# EasyEDA Pro project kuafu01_030内部老化方案.eprj, board PCB4 (continued)
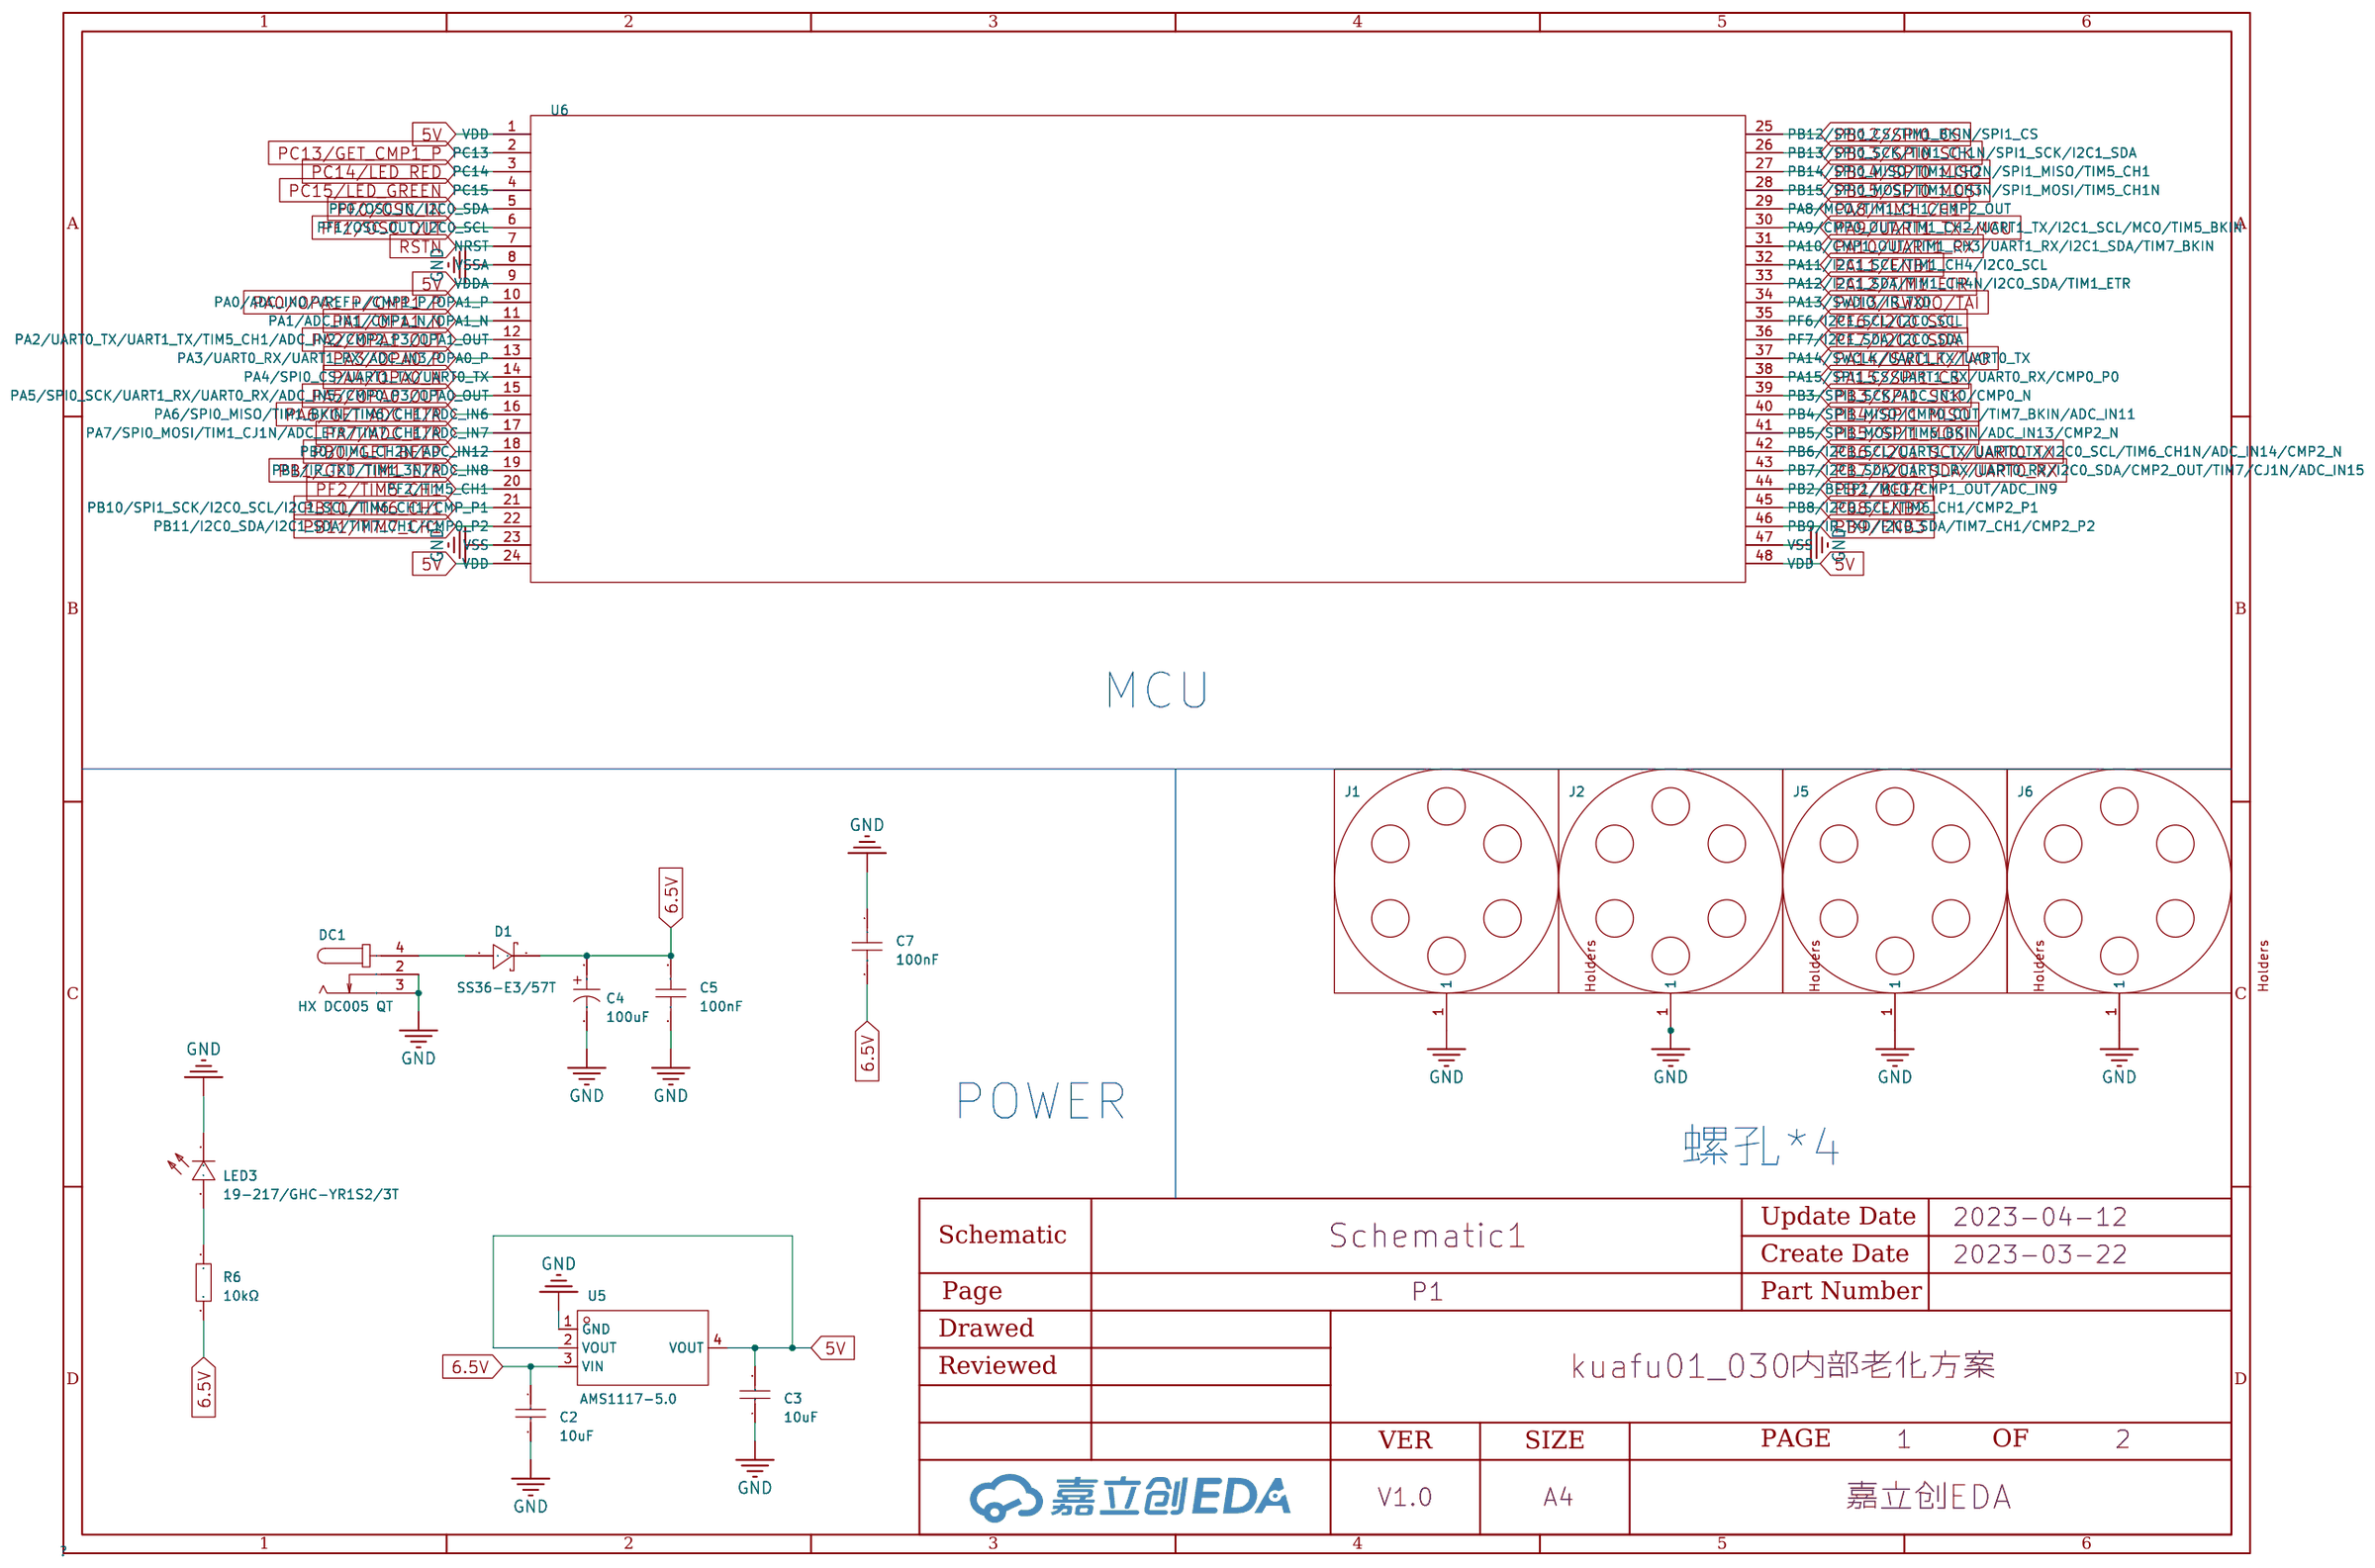
[diagram p0: P1]
## Routing (per net, layer and track width the routed paths; a pad name or vN(x,y) marks a point on that pad's centre or on a via; arc(x,y) is an arc through that point) (continued)
PF1/OSC_OUT: length 478.7
  Top Layer w0.254: 239.24,333.24 240.66,331.81 250.62,331.81 ; 36.04,180.84 37.46,179.41 47.42,179.41 ; 188.44,79.24 189.86,77.81 199.82,77.81 ; 199.82,128.61 189.86,128.61 188.44,130.04 ; 188.44,231.64 189.86,230.21 199.82,230.21 ; 250.62,27.01 240.66,27.01 239.24,28.44 ; 86.84,28.44 88.26,27.01 98.22,27.01 ; 250.62,281.01 240.66,281.01 239.24,282.44 ; 98.22,128.61 88.26,128.61 86.84,130.04 ; 290.04,231.64 291.46,230.21 301.42,230.21 ; 137.64,180.84 139.06,179.41 149.02,179.41 ; 290.04,79.24 291.46,77.81 301.42,77.81 ; 137.64,282.44 139.06,281.01 149.02,281.01 ; 36.04,79.24 37.46,77.81 47.42,77.81 ; 36.04,231.64 37.46,230.21 47.42,230.21 ; 137.64,231.64 139.06,230.21 149.02,230.21 ; 149.02,27.01 139.06,27.01 137.64,28.44 ; 149.02,77.81 139.06,77.81 137.64,79.24 ; 86.84,282.44 88.26,281.01 98.22,281.01 ; 301.42,281.01 291.46,281.01 290.04,282.44 ; 86.84,79.24 88.26,77.81 98.22,77.81 ; 239.24,130.04 240.66,128.61 250.62,128.61 ; 188.44,282.44 189.86,281.01 199.82,281.01 ; 188.44,333.24 189.86,331.81 199.82,331.81 ; 301.42,128.61 291.46,128.61 290.04,130.04 ; 188.44,28.44 189.86,27.01 199.82,27.01 ; 250.62,77.81 240.66,77.81 239.24,79.24 ; 98.22,230.21 88.26,230.21 86.84,231.64 ; 137.64,333.24 139.06,331.81 149.02,331.81 ; 36.04,28.44 37.46,27.01 47.42,27.01 ; 137.64,130.04 139.06,128.61 149.02,128.61 ; 36.04,282.44 37.46,281.01 47.42,281.01 ; 290.04,180.84 291.46,179.41 301.42,179.41 ; 250.62,179.41 240.66,179.41 239.24,180.84 ; 199.82,179.41 189.86,179.41 188.44,180.84 ; 290.04,333.24 291.46,331.81 301.42,331.81 ; 98.22,331.81 88.26,331.81 86.84,333.24 ; 47.42,128.61 37.46,128.61 36.04,130.04 ; 98.22,179.41 88.26,179.41 86.84,180.84 ; 250.62,230.21 240.66,230.21 239.24,231.64
PF6/I2C0_SCL: length 555
  Top Layer w0.254: 213.88,182.58 213.88,182.34 213.57,182.03 211.85,182.03 v1(211.62,181.79) 211.52,181.79 211.12,181.4 208.22,181.4 ; 213.88,334.98 213.88,334.74 213.57,334.43 211.85,334.43 v1(211.62,334.19) 211.52,334.19 211.12,333.8 208.22,333.8 ; 264.68,182.58 264.68,182.34 264.37,182.03 262.65,182.03 v1(262.42,181.79) 262.32,181.79 261.92,181.4 259.02,181.4 ; 59.23,123.75 59.57,124.09 v1(59.57,124.99) ; 213.88,233.38 213.88,233.14 213.57,232.83 211.85,232.83 v1(211.62,232.59) 211.52,232.59 211.12,232.2 208.22,232.2 ; 59.23,72.95 59.57,73.29 v1(59.57,74.19) ; v1(110.37,74.19) 110.37,73.29 110.03,72.95 ; 106.62,181.4 109.52,181.4 109.92,181.79 v1(110.02,181.79) 110.25,182.03 111.97,182.03 112.28,182.34 112.28,182.58 ; 110.03,174.55 110.37,174.89 v1(110.37,175.79) ; 211.63,326.95 211.97,327.29 v1(211.97,328.19) ; 259.02,130.6 261.92,130.6 262.32,130.99 v1(262.42,130.99) 262.65,131.23 264.37,131.23 264.68,131.54 264.68,131.78 ; 309.82,283 312.72,283 313.12,283.39 v1(313.22,283.39) 313.45,283.63 315.17,283.63 315.48,283.94 315.48,284.18 ; 259.02,232.2 261.92,232.2 262.32,232.59 v1(262.42,232.59) 262.65,232.83 264.37,232.83 264.68,233.14 264.68,233.38 ; v1(211.97,74.19) 211.97,73.29 211.63,72.95 ; v1(161.17,124.99) 161.17,124.09 160.83,123.75 ; 315.48,131.78 315.48,131.54 315.17,131.23 313.45,131.23 v1(313.22,130.99) 313.12,130.99 312.72,130.6 309.82,130.6 ; v1(110.37,328.19) 110.37,327.29 110.03,326.95 ; 106.62,232.2 109.52,232.2 109.92,232.59 v1(110.02,232.59) 110.25,232.83 111.97,232.83 112.28,233.14 112.28,233.38 ; 160.83,326.95 161.17,327.29 v1(161.17,328.19) ; 208.22,79.8 211.12,79.8 211.52,80.19 v1(211.62,80.19) 211.85,80.43 213.57,80.43 213.88,80.74 213.88,80.98 ; 208.22,283 211.12,283 211.52,283.39 v1(211.62,283.39) 211.85,283.63 213.57,283.63 213.88,283.94 213.88,284.18 ; v1(313.57,124.99) 313.57,124.09 313.23,123.75 ; 59.23,22.15 59.57,22.49 v1(59.57,23.39) ; 55.82,29 58.72,29 59.12,29.39 v1(59.22,29.39) 59.45,29.63 61.17,29.63 61.48,29.94 61.48,30.18 ; v1(262.77,74.19) 262.77,73.29 262.43,72.95 ; 264.68,334.98 264.68,334.74 264.37,334.43 262.65,334.43 v1(262.42,334.19) 262.32,334.19 261.92,333.8 259.02,333.8 ; 315.48,334.98 315.48,334.74 315.17,334.43 313.45,334.43 v1(313.22,334.19) 313.12,334.19 312.72,333.8 309.82,333.8 ; 309.82,79.8 312.72,79.8 313.12,80.19 v1(313.22,80.19) 313.45,80.43 315.17,80.43 315.48,80.74 315.48,80.98 ; 157.42,283 160.32,283 160.72,283.39 v1(160.82,283.39) 161.05,283.63 162.77,283.63 163.08,283.94 163.08,284.18 ; 213.88,30.18 213.88,29.94 213.57,29.63 211.85,29.63 v1(211.62,29.39) 211.52,29.39 211.12,29 208.22,29 ; 110.03,225.35 110.37,225.69 v1(110.37,226.59) ; 259.02,29 261.92,29 262.32,29.39 v1(262.42,29.39) 262.65,29.63 264.37,29.63 264.68,29.94 264.68,30.18 ; 106.62,333.8 109.52,333.8 109.92,334.19 v1(110.02,334.19) 110.25,334.43 111.97,334.43 112.28,334.74 112.28,334.98 ; 211.63,174.55 211.97,174.89 v1(211.97,175.79) ; 160.83,72.95 161.17,73.29 v1(161.17,74.19) ; v1(313.57,74.19) 313.57,73.29 313.23,72.95 ; v1(161.17,277.39) 161.17,276.49 160.83,276.15 ; 110.03,123.75 110.37,124.09 v1(110.37,124.99) ; 61.48,182.58 61.48,182.34 61.17,182.03 59.45,182.03 v1(59.22,181.79) 59.12,181.79 58.72,181.4 55.82,181.4 ; 262.43,225.35 262.77,225.69 v1(262.77,226.59) ; 211.63,225.35 211.97,225.69 v1(211.97,226.59) ; 163.08,80.98 163.08,80.74 162.77,80.43 161.05,80.43 v1(160.82,80.19) 160.72,80.19 160.32,79.8 157.42,79.8 ; 211.63,22.15 211.97,22.49 v1(211.97,23.39) ; 59.23,276.15 59.57,276.49 v1(59.57,277.39) ; 112.28,80.98 112.28,80.74 111.97,80.43 110.25,80.43 v1(110.02,80.19) 109.92,80.19 109.52,79.8 106.62,79.8 ; v1(313.57,175.79) 313.57,174.89 313.23,174.55 ; 112.28,284.18 112.28,283.94 111.97,283.63 110.25,283.63 v1(110.02,283.39) 109.92,283.39 109.52,283 106.62,283 ; 262.43,276.15 262.77,276.49 v1(262.77,277.39) ; 315.48,233.38 315.48,233.14 315.17,232.83 313.45,232.83 v1(313.22,232.59) 313.12,232.59 312.72,232.2 309.82,232.2 ; 112.28,131.78 112.28,131.54 111.97,131.23 110.25,131.23 v1(110.02,130.99) 109.92,130.99 109.52,130.6 106.62,130.6 ; 313.23,276.15 313.57,276.49 v1(313.57,277.39) ; v1(161.17,226.59) 161.17,225.69 160.83,225.35 ; v1(211.97,277.39) 211.97,276.49 211.63,276.15 ; 163.08,182.58 163.08,182.34 162.77,182.03 161.05,182.03 v1(160.82,181.79) 160.72,181.79 160.32,181.4 157.42,181.4 ; 157.42,232.2 160.32,232.2 160.72,232.59 v1(160.82,232.59) 161.05,232.83 162.77,232.83 163.08,233.14 163.08,233.38 ; v1(211.97,124.99) 211.97,124.09 211.63,123.75 ; 262.43,174.55 262.77,174.89 v1(262.77,175.79) ; 157.42,333.8 160.32,333.8 160.72,334.19 v1(160.82,334.19) 161.05,334.43 162.77,334.43 163.08,334.74 163.08,334.98 ; 112.28,30.18 112.28,29.94 111.97,29.63 110.25,29.63 v1(110.02,29.39) 109.92,29.39 109.52,29 106.62,29 ; v1(262.77,124.99) 262.77,124.09 262.43,123.75 ; 157.42,130.6 160.32,130.6 160.72,130.99 v1(160.82,130.99) 161.05,131.23 162.77,131.23 163.08,131.54 163.08,131.78 ; v1(59.57,226.59) 59.57,225.69 59.23,225.35 ; v1(313.57,328.19) 313.57,327.29 313.23,326.95 ; 163.08,30.18 163.08,29.94 162.77,29.63 161.05,29.63 v1(160.82,29.39) 160.72,29.39 160.32,29 157.42,29 ; v1(110.37,23.39) 110.37,22.49 110.03,22.15 ; 264.68,284.18 264.68,283.94 264.37,283.63 262.65,283.63 v1(262.42,283.39) 262.32,283.39 261.92,283 259.02,283 ; 55.82,232.2 58.72,232.2 59.12,232.59 v1(59.22,232.59) 59.45,232.83 61.17,232.83 61.48,233.14 61.48,233.38 ; 61.48,284.18 61.48,283.94 61.17,283.63 59.45,283.63 v1(59.22,283.39) 59.12,283.39 58.72,283 55.82,283 ; 315.48,182.58 315.48,182.34 315.17,182.03 313.45,182.03 v1(313.22,181.79) 313.12,181.79 312.72,181.4 309.82,181.4 ; 55.82,130.6 58.72,130.6 59.12,130.99 v1(59.22,130.99) 59.45,131.23 61.17,131.23 61.48,131.54 61.48,131.78 ; 110.03,276.15 110.37,276.49 v1(110.37,277.39) ; v1(313.57,226.59) 313.57,225.69 313.23,225.35 ; 160.83,174.55 161.17,174.89 v1(161.17,175.79) ; 264.68,80.98 264.68,80.74 264.37,80.43 262.65,80.43 v1(262.42,80.19) 262.32,80.19 261.92,79.8 259.02,79.8 ; 262.43,22.15 262.77,22.49 v1(262.77,23.39) ; 262.43,326.95 262.77,327.29 v1(262.77,328.19) ; 55.82,79.8 58.72,79.8 59.12,80.19 v1(59.22,80.19) 59.45,80.43 61.17,80.43 61.48,80.74 61.48,80.98 ; 59.23,174.55 59.57,174.89 v1(59.57,175.79) ; 213.88,131.78 213.88,131.54 213.57,131.23 211.85,131.23 v1(211.62,130.99) 211.52,130.99 211.12,130.6 208.22,130.6 ; 160.83,22.15 161.17,22.49 v1(161.17,23.39)
  Bottom Layer w0.254: v1(160.82,130.99) 161.23,130.58 161.23,125.04 v1(161.17,124.99) ; v1(161.17,277.39) 161.23,277.44 161.23,282.98 v1(160.82,283.39) ; v1(262.77,175.79) 262.82,175.84 262.82,181.38 v1(262.42,181.79) ; v1(110.37,277.39) 110.42,277.44 110.42,282.98 v1(110.02,283.39) ; v1(262.77,124.99) 262.82,125.04 262.82,130.58 v1(262.42,130.99) ; v1(110.02,80.19) 110.42,79.78 110.42,74.24 v1(110.37,74.19) ; v1(161.17,226.59) 161.23,226.64 161.23,232.18 v1(160.82,232.59) ; v1(262.77,277.39) 262.82,277.44 262.82,282.98 v1(262.42,283.39) ; v1(262.42,80.19) 262.82,79.78 262.82,74.24 v1(262.77,74.19) ; v1(313.22,181.79) 313.62,181.38 313.62,175.84 v1(313.57,175.79) ; v1(211.97,328.19) 212.03,328.24 212.03,333.78 v1(211.62,334.19) ; v1(161.17,74.19) 161.23,74.24 161.23,79.78 v1(160.82,80.19) ; v1(160.82,334.19) 161.23,333.78 161.23,328.24 v1(161.17,328.19) ; v1(59.57,124.99) 59.62,125.04 59.62,130.58 v1(59.22,130.99) ; v1(110.02,130.99) 110.42,130.58 110.42,125.04 v1(110.37,124.99) ; v1(262.42,334.19) 262.82,333.78 262.82,328.24 v1(262.77,328.19) ; v1(262.77,23.39) 262.82,23.44 262.82,28.98 v1(262.42,29.39) ; v1(211.97,226.59) 212.03,226.64 212.03,232.18 v1(211.62,232.59) ; v1(59.57,23.39) 59.62,23.44 59.62,28.98 v1(59.22,29.39) ; v1(110.37,23.39) 110.42,23.44 110.42,28.98 v1(110.02,29.39) ; v1(110.02,334.19) 110.42,333.78 110.42,328.24 v1(110.37,328.19) ; v1(211.62,130.99) 212.03,130.58 212.03,125.04 v1(211.97,124.99) ; v1(211.62,80.19) 212.03,79.78 212.03,74.24 v1(211.97,74.19) ; v1(313.22,80.19) 313.62,79.78 313.62,74.24 v1(313.57,74.19) ; v1(59.22,80.19) 59.62,79.78 59.62,74.24 v1(59.57,74.19) ; v1(59.57,277.39) 59.62,277.44 59.62,282.98 v1(59.22,283.39) ; v1(110.02,232.59) 110.42,232.18 110.42,226.64 v1(110.37,226.59) ; v1(59.57,226.59) 59.62,226.64 59.62,232.18 v1(59.22,232.59) ; v1(59.22,181.79) 59.62,181.38 59.62,175.84 v1(59.57,175.79) ; v1(110.02,181.79) 110.42,181.38 110.42,175.84 v1(110.37,175.79) ; v1(313.57,226.59) 313.62,226.64 313.62,232.18 v1(313.22,232.59) ; v1(211.62,29.39) 212.03,28.98 212.03,23.44 v1(211.97,23.39) ; v1(211.62,181.79) 212.03,181.38 212.03,175.84 v1(211.97,175.79) ; v1(313.57,328.19) 313.62,328.24 313.62,333.78 v1(313.22,334.19) ; v1(161.17,175.79) 161.23,175.84 161.23,181.38 v1(160.82,181.79) ; v1(313.22,130.99) 313.62,130.58 313.62,125.04 v1(313.57,124.99) ; v1(262.77,226.59) 262.82,226.64 262.82,232.18 v1(262.42,232.59) ; v1(211.97,277.39) 212.03,277.44 212.03,282.98 v1(211.62,283.39) ; v1(161.17,23.39) 161.23,23.44 161.23,28.98 v1(160.82,29.39) ; v1(313.57,277.39) 313.62,277.44 313.62,282.98 v1(313.22,283.39)
PF7/I2C0_SDA: length 1019.3
  Top Layer w0.254: v1(209.15,284.56) 208.11,283.51 207.96,283.51 ; v1(99.48,339.39) 97.61,339.39 97.02,339.98 ; 249.42,85.98 250.01,85.39 v1(251.88,85.39) ; v1(158.35,132.16) 157.31,131.11 157.16,131.11 ; 258.76,131.11 258.91,131.11 v1(259.95,132.16) ; 198.62,136.78 199.21,136.19 v1(201.08,136.19) ; v1(108.4,22.14) 108.4,20.73 108.65,20.48 109.53,20.48 ; v1(209.15,30.56) 208.11,29.51 207.96,29.51 ; v1(48.68,288.59) 46.81,288.59 46.22,289.18 ; v1(56.75,132.16) 55.71,131.11 55.56,131.11 ; v1(209.15,132.16) 208.11,131.11 207.96,131.11 ; v1(251.88,34.59) 250.01,34.59 249.42,35.18 ; 300.22,85.98 300.81,85.39 v1(302.68,85.39) ; v1(302.68,339.39) 300.81,339.39 300.22,339.98 ; 309.56,334.31 309.71,334.31 v1(310.75,335.36) ; 261.93,325.28 261.05,325.28 260.8,325.53 v1(260.8,326.94) ; v1(302.68,186.99) 300.81,186.99 300.22,187.58 ; 55.56,181.91 55.71,181.91 v1(56.75,182.95) ; v1(48.68,85.39) 46.81,85.39 46.22,85.98 ; v1(150.28,85.39) 148.41,85.39 147.82,85.98 ; v1(150.28,136.19) 148.41,136.19 147.82,136.78 ; 109.53,172.88 108.65,172.88 108.4,173.13 v1(108.4,174.54) ; 160.33,122.08 159.45,122.08 159.2,122.33 v1(159.2,123.74) ; v1(260.8,276.14) 260.8,274.73 261.05,274.48 261.93,274.48 ; v1(259.95,182.95) 258.91,181.91 258.76,181.91 ; v1(210,72.94) 210,71.53 210.25,71.28 211.13,71.28 ; 211.13,274.48 210.25,274.48 210,274.73 v1(210,276.14) ; 157.16,181.91 157.31,181.91 v1(158.35,182.95) ; 261.93,20.48 261.05,20.48 260.8,20.73 v1(260.8,22.14) ; 157.16,232.71 157.31,232.71 v1(158.35,233.75) ; 300.22,289.18 300.81,288.59 v1(302.68,288.59) ; 258.76,232.71 258.91,232.71 v1(259.95,233.75) ; v1(251.88,288.59) 250.01,288.59 249.42,289.18 ; 106.36,283.51 106.51,283.51 v1(107.55,284.56) ; 249.42,187.58 250.01,186.99 v1(251.88,186.99) ; 300.22,136.78 300.81,136.19 v1(302.68,136.19) ; 157.16,334.31 157.31,334.31 v1(158.35,335.36) ; 261.93,172.88 261.05,172.88 260.8,173.13 v1(260.8,174.54) ; v1(99.48,85.39) 97.61,85.39 97.02,85.98 ; v1(150.28,237.79) 148.41,237.79 147.82,238.38 ; 309.56,80.31 309.71,80.31 v1(310.75,81.35) ; 261.93,122.08 261.05,122.08 260.8,122.33 v1(260.8,123.74) ; v1(210,123.74) 210,122.33 210.25,122.08 211.13,122.08 ; v1(57.6,22.14) 57.6,20.73 57.85,20.48 58.73,20.48 ; 207.96,181.91 208.11,181.91 v1(209.15,182.95) ; v1(210,225.34) 210,223.93 210.25,223.68 211.13,223.68 ; v1(311.6,225.34) 311.6,223.93 311.85,223.68 312.73,223.68 ; 211.13,20.48 210.25,20.48 210,20.73 v1(210,22.14) ; 258.76,283.51 258.91,283.51 v1(259.95,284.56) ; v1(251.88,339.39) 250.01,339.39 249.42,339.98 ; 46.22,136.78 46.81,136.19 v1(48.68,136.19) ; v1(259.95,335.36) 258.91,334.31 258.76,334.31 ; v1(159.2,276.14) 159.2,274.73 159.45,274.48 160.33,274.48 ; 147.82,35.18 148.41,34.59 v1(150.28,34.59) ; 157.16,283.51 157.31,283.51 v1(158.35,284.56) ; v1(107.55,233.75) 106.51,232.71 106.36,232.71 ; v1(310.75,132.16) 309.71,131.11 309.56,131.11 ; v1(311.6,174.54) 311.6,173.13 311.85,172.88 312.73,172.88 ; v1(56.75,30.56) 55.71,29.51 55.56,29.51 ; v1(311.6,276.14) 311.6,274.73 311.85,274.48 312.73,274.48 ; v1(108.4,326.94) 108.4,325.53 108.65,325.28 109.53,325.28 ; 160.33,223.68 159.45,223.68 159.2,223.93 v1(159.2,225.34) ; 309.56,181.91 309.71,181.91 v1(310.75,182.95) ; v1(311.6,123.74) 311.6,122.33 311.85,122.08 312.73,122.08 ; v1(48.68,186.99) 46.81,186.99 46.22,187.58 ; v1(108.4,225.34) 108.4,223.93 108.65,223.68 109.53,223.68 ; v1(108.4,276.14) 108.4,274.73 108.65,274.48 109.53,274.48 ; v1(108.4,123.74) 108.4,122.33 108.65,122.08 109.53,122.08 ; v1(310.75,233.75) 309.71,232.71 309.56,232.71 ; 258.76,29.51 258.91,29.51 v1(259.95,30.56) ; 58.73,223.68 57.85,223.68 57.6,223.93 v1(57.6,225.34) ; 55.56,80.31 55.71,80.31 v1(56.75,81.35) ; 198.62,289.18 199.21,288.59 v1(201.08,288.59) ; 261.93,223.68 261.05,223.68 260.8,223.93 v1(260.8,225.34) ; 198.62,238.38 199.21,237.79 v1(201.08,237.79) ; 97.02,238.38 97.61,237.79 v1(99.48,237.79) ; 106.36,334.31 106.51,334.31 v1(107.55,335.36) ; 249.42,136.78 250.01,136.19 v1(251.88,136.19) ; 97.02,136.78 97.61,136.19 v1(99.48,136.19) ; 198.62,339.98 199.21,339.39 v1(201.08,339.39) ; 147.82,187.58 148.41,186.99 v1(150.28,186.99) ; v1(259.95,81.35) 258.91,80.31 258.76,80.31 ; 58.73,71.28 57.85,71.28 57.6,71.53 v1(57.6,72.94) ; v1(201.08,85.39) 199.21,85.39 198.62,85.98 ; v1(107.55,182.95) 106.51,181.91 106.36,181.91 ; v1(159.2,22.14) 159.2,20.73 159.45,20.48 160.33,20.48 ; 106.36,80.31 106.51,80.31 v1(107.55,81.35) ; 312.73,325.28 311.85,325.28 311.6,325.53 v1(311.6,326.94) ; 97.02,187.58 97.61,186.99 v1(99.48,186.99) ; v1(158.35,30.56) 157.31,29.51 157.16,29.51 ; 46.22,238.38 46.81,237.79 v1(48.68,237.79) ; v1(210,174.54) 210,173.13 210.25,172.88 211.13,172.88 ; 261.93,71.28 261.05,71.28 260.8,71.53 v1(260.8,72.94) ; 300.22,238.38 300.81,237.79 v1(302.68,237.79) ; v1(56.75,284.56) 55.71,283.51 55.56,283.51 ; 109.53,71.28 108.65,71.28 108.4,71.53 v1(108.4,72.94) ; 207.96,334.31 208.11,334.31 v1(209.15,335.36) ; v1(150.28,288.59) 148.41,288.59 147.82,289.18 ; v1(159.2,326.94) 159.2,325.53 159.45,325.28 160.33,325.28 ; 106.36,29.51 106.51,29.51 v1(107.55,30.56) ; v1(201.08,34.59) 199.21,34.59 198.62,35.18 ; v1(99.48,34.59) 97.61,34.59 97.02,35.18 ; v1(150.28,339.39) 148.41,339.39 147.82,339.98 ; 157.16,80.31 157.31,80.31 v1(158.35,81.35) ; 55.56,232.71 55.71,232.71 v1(56.75,233.75) ; v1(57.6,276.14) 57.6,274.73 57.85,274.48 58.73,274.48 ; 211.13,325.28 210.25,325.28 210,325.53 v1(210,326.94) ; 198.62,187.58 199.21,186.99 v1(201.08,186.99) ; v1(159.2,174.54) 159.2,173.13 159.45,172.88 160.33,172.88 ; 58.73,172.88 57.85,172.88 57.6,173.13 v1(57.6,174.54) ; v1(209.15,233.75) 208.11,232.71 207.96,232.71 ; 249.42,238.38 250.01,237.79 v1(251.88,237.79) ; 58.73,122.08 57.85,122.08 57.6,122.33 v1(57.6,123.74) ; 106.36,131.11 106.51,131.11 v1(107.55,132.16) ; v1(48.68,34.59) 46.81,34.59 46.22,35.18 ; 312.73,71.28 311.85,71.28 311.6,71.53 v1(311.6,72.94) ; 97.02,289.18 97.61,288.59 v1(99.48,288.59) ; 207.96,80.31 208.11,80.31 v1(209.15,81.35) ; 309.56,283.51 309.71,283.51 v1(310.75,284.56) ; 160.33,71.28 159.45,71.28 159.2,71.53 v1(159.2,72.94)
  Bottom Layer w0.254: v1(260.8,225.34) 260.8,232.91 v1(259.95,233.75) 255.98,237.73 251.94,237.73 v1(251.88,237.79) ; v1(251.88,34.59) 251.94,34.53 255.98,34.53 v1(259.95,30.56) 260.8,29.71 v1(260.8,22.14) ; v1(201.08,136.19) 201.14,136.13 205.18,136.13 v1(209.15,132.16) 210,131.31 v1(210,123.74) ; v1(251.88,85.39) 251.94,85.33 255.98,85.33 v1(259.95,81.35) 260.8,80.51 v1(260.8,72.94) ; v1(99.48,34.59) 99.54,34.53 103.58,34.53 v1(107.55,30.56) 108.4,29.71 v1(108.4,22.14) ; v1(311.6,123.74) 311.6,131.31 v1(310.75,132.16) 306.78,136.13 302.74,136.13 v1(302.68,136.19) ; v1(108.4,326.94) 108.4,334.51 v1(107.55,335.36) 103.58,339.33 99.54,339.33 v1(99.48,339.39) ; v1(57.6,22.14) 57.6,29.71 v1(56.75,30.56) 52.78,34.53 48.74,34.53 v1(48.68,34.59) ; v1(48.68,136.19) 48.74,136.13 52.78,136.13 v1(56.75,132.16) 57.6,131.31 v1(57.6,123.74) ; v1(48.68,288.59) 48.74,288.53 52.78,288.53 v1(56.75,284.56) 57.6,283.71 v1(57.6,276.14) ; v1(99.48,136.19) 99.54,136.13 103.58,136.13 v1(107.55,132.16) 108.4,131.31 v1(108.4,123.74) ; v1(201.08,288.59) 201.14,288.53 205.18,288.53 v1(209.15,284.56) 210,283.71 v1(210,276.14) ; v1(108.4,225.34) 108.4,232.91 v1(107.55,233.75) 103.58,237.73 99.54,237.73 v1(99.48,237.79) ; v1(302.68,85.39) 302.74,85.33 306.78,85.33 v1(310.75,81.35) 311.6,80.51 v1(311.6,72.94) ; v1(251.88,339.39) 251.94,339.33 255.98,339.33 v1(259.95,335.36) 260.8,334.51 v1(260.8,326.94) ; v1(201.08,34.59) 201.14,34.53 205.18,34.53 v1(209.15,30.56) 210,29.71 v1(210,22.14) ; v1(150.28,339.39) 150.34,339.33 154.38,339.33 v1(158.35,335.36) 159.2,334.51 v1(159.2,326.94) ; v1(302.68,339.39) 302.74,339.33 306.78,339.33 v1(310.75,335.36) 311.6,334.51 v1(311.6,326.94) ; v1(210,225.34) 210,232.91 v1(209.15,233.75) 205.18,237.73 201.14,237.73 v1(201.08,237.79) ; v1(260.8,174.54) 260.8,182.11 v1(259.95,182.95) 255.98,186.93 251.94,186.93 v1(251.88,186.99) ; v1(48.68,237.79) 48.74,237.73 52.78,237.73 v1(56.75,233.75) 57.6,232.91 v1(57.6,225.34) ; v1(48.68,186.99) 48.74,186.93 52.78,186.93 v1(56.75,182.95) 57.6,182.11 v1(57.6,174.54) ; v1(159.2,22.14) 159.2,29.71 v1(158.35,30.56) 154.38,34.53 150.34,34.53 v1(150.28,34.59) ; v1(201.08,339.39) 201.14,339.33 205.18,339.33 v1(209.15,335.36) 210,334.51 v1(210,326.94) ; v1(311.6,174.54) 311.6,182.11 v1(310.75,182.95) 306.78,186.93 302.74,186.93 v1(302.68,186.99) ; v1(150.28,237.79) 150.34,237.73 154.38,237.73 v1(158.35,233.75) 159.2,232.91 v1(159.2,225.34) ; v1(159.2,123.74) 159.2,131.31 v1(158.35,132.16) 154.38,136.13 150.34,136.13 v1(150.28,136.19) ; v1(201.08,85.39) 201.14,85.33 205.18,85.33 v1(209.15,81.35) 210,80.51 v1(210,72.94) ; v1(108.4,72.94) 108.4,80.51 v1(107.55,81.35) 103.58,85.33 99.54,85.33 v1(99.48,85.39) ; v1(302.68,237.79) 302.74,237.73 306.78,237.73 v1(310.75,233.75) 311.6,232.91 v1(311.6,225.34) ; v1(108.4,276.14) 108.4,283.71 v1(107.55,284.56) 103.58,288.53 99.54,288.53 v1(99.48,288.59) ; v1(311.6,276.14) 311.6,283.71 v1(310.75,284.56) 306.78,288.53 302.74,288.53 v1(302.68,288.59) ; v1(260.8,276.14) 260.8,283.71 v1(259.95,284.56) 255.98,288.53 251.94,288.53 v1(251.88,288.59) ; v1(159.2,72.94) 159.2,80.51 v1(158.35,81.35) 154.38,85.33 150.34,85.33 v1(150.28,85.39) ; v1(210,174.54) 210,182.11 v1(209.15,182.95) 205.18,186.93 201.14,186.93 v1(201.08,186.99) ; v1(57.6,72.94) 57.6,80.51 v1(56.75,81.35) 52.78,85.33 48.74,85.33 v1(48.68,85.39) ; v1(260.8,123.74) 260.8,131.31 v1(259.95,132.16) 255.98,136.13 251.94,136.13 v1(251.88,136.19) ; v1(150.28,288.59) 150.34,288.53 154.38,288.53 v1(158.35,284.56) 159.2,283.71 v1(159.2,276.14) ; v1(108.4,174.54) 108.4,182.11 v1(107.55,182.95) 103.58,186.93 99.54,186.93 v1(99.48,186.99) ; v1(159.2,174.54) 159.2,182.11 v1(158.35,182.95) 154.38,186.93 150.34,186.93 v1(150.28,186.99)
RSTN: length 1815.9
  Top Layer w0.254: 158.32,343.33 156.87,341.88 v1(155.99,341.88) ; v1(85.36,77.79) 85.84,77.3 98.34,77.3 ; 209.12,343.33 207.67,341.88 v1(206.79,341.88) ; 47.54,280.5 35.05,280.5 v1(34.56,280.99) ; v1(237.76,77.79) 238.25,77.3 250.74,77.3 ; 199.94,128.1 187.45,128.1 v1(186.96,128.59) ; v1(136.16,331.79) 136.65,331.31 149.14,331.31 ; 98.34,128.1 85.84,128.1 v1(85.36,128.59) ; 250.74,178.9 238.25,178.9 v1(237.76,179.39) ; 259.92,241.73 258.47,240.28 v1(257.59,240.28) ; 259.92,38.53 258.47,37.08 v1(257.59,37.08) ; v1(206.79,189.48) 207.67,189.48 209.12,190.93 ; v1(155.99,291.08) 156.87,291.08 158.32,292.53 ; v1(308.39,240.28) 309.27,240.28 310.72,241.73 ; v1(105.19,240.28) 106.07,240.28 107.52,241.73 ; 199.94,26.5 187.45,26.5 v1(186.96,26.99) ; 259.92,292.53 258.47,291.08 v1(257.59,291.08) ; v1(105.19,291.08) 106.07,291.08 107.52,292.53 ; 98.34,229.7 85.84,229.7 v1(85.36,230.19) ; 98.34,280.5 85.84,280.5 v1(85.36,280.99) ; v1(206.79,138.68) 207.67,138.68 209.12,140.13 ; v1(136.16,179.39) 136.65,178.9 149.14,178.9 ; v1(288.56,280.99) 289.04,280.5 301.54,280.5 ; v1(257.59,138.68) 258.47,138.68 259.92,140.13 ; 199.94,178.9 187.45,178.9 v1(186.96,179.39) ; v1(136.16,128.59) 136.65,128.1 149.14,128.1 ; 250.74,128.1 238.25,128.1 v1(237.76,128.59) ; v1(206.79,87.88) 207.67,87.88 209.12,89.33 ; 98.34,178.9 85.84,178.9 v1(85.36,179.39) ; 158.32,241.73 156.87,240.28 v1(155.99,240.28) ; 199.94,229.7 187.45,229.7 v1(186.96,230.19) ; v1(105.19,138.68) 106.07,138.68 107.52,140.13 ; 259.92,89.33 258.47,87.88 v1(257.59,87.88) ; v1(155.99,138.68) 156.87,138.68 158.32,140.13 ; 259.92,343.33 258.47,341.88 v1(257.59,341.88) ; v1(308.39,189.48) 309.27,189.48 310.72,190.93 ; 259.92,190.93 258.47,189.48 v1(257.59,189.48) ; v1(136.16,77.79) 136.65,77.3 149.14,77.3 ; v1(288.56,128.59) 289.04,128.1 301.54,128.1 ; 149.14,229.7 136.65,229.7 v1(136.16,230.19) ; 209.12,292.53 207.67,291.08 v1(206.79,291.08) ; 199.94,280.5 187.45,280.5 v1(186.96,280.99) ; v1(288.56,331.79) 289.04,331.31 301.54,331.31 ; v1(34.56,179.39) 35.05,178.9 47.54,178.9 ; v1(155.99,189.48) 156.87,189.48 158.32,190.93 ; 56.72,38.53 55.27,37.08 v1(54.39,37.08) ; v1(54.39,189.48) 55.27,189.48 56.72,190.93 ; v1(237.76,230.19) 238.25,229.7 250.74,229.7 ; v1(136.16,26.99) 136.65,26.5 149.14,26.5 ; v1(186.96,77.79) 187.45,77.3 199.94,77.3 ; v1(54.39,240.28) 55.27,240.28 56.72,241.73 ; 310.72,292.53 309.27,291.08 v1(308.39,291.08) ; 301.54,178.9 289.04,178.9 v1(288.56,179.39) ; 98.34,26.5 85.84,26.5 v1(85.36,26.99) ; 47.54,229.7 35.05,229.7 v1(34.56,230.19) ; v1(206.79,240.28) 207.67,240.28 209.12,241.73 ; v1(237.76,280.99) 238.25,280.5 250.74,280.5 ; 47.54,77.3 35.05,77.3 v1(34.56,77.79) ; v1(288.56,230.19) 289.04,229.7 301.54,229.7 ; v1(105.19,341.88) 106.07,341.88 107.52,343.33 ; 56.72,140.13 55.27,138.68 v1(54.39,138.68) ; v1(136.16,280.99) 136.65,280.5 149.14,280.5 ; v1(237.76,331.79) 238.25,331.31 250.74,331.31 ; v1(237.76,26.99) 238.25,26.5 250.74,26.5 ; v1(34.56,128.59) 35.05,128.1 47.54,128.1 ; v1(308.39,341.88) 309.27,341.88 310.72,343.33 ; v1(308.39,138.68) 309.27,138.68 310.72,140.13 ; v1(186.96,331.79) 187.45,331.31 199.94,331.31 ; 310.72,89.33 309.27,87.88 v1(308.39,87.88) ; v1(155.99,37.08) 156.87,37.08 158.32,38.53 ; v1(105.19,37.08) 106.07,37.08 107.52,38.53 ; v1(85.36,331.79) 85.84,331.31 98.34,331.31 ; 209.12,38.53 207.67,37.08 v1(206.79,37.08) ; v1(288.56,77.79) 289.04,77.3 301.54,77.3 ; v1(155.99,87.88) 156.87,87.88 158.32,89.33 ; 56.72,292.53 55.27,291.08 v1(54.39,291.08) ; v1(34.56,26.99) 35.05,26.5 47.54,26.5 ; v1(105.19,87.88) 106.07,87.88 107.52,89.33 ; 56.72,89.33 55.27,87.88 v1(54.39,87.88) ; 107.52,190.93 106.07,189.48 v1(105.19,189.48)
  Bottom Layer w0.254: v1(186.96,26.99) 186.96,36 188.03,37.08 206.79,37.08 ; 206.79,291.08 188.03,291.08 186.96,290 v1(186.96,280.99) ; 308.39,240.28 289.63,240.28 288.56,239.2 v1(288.56,230.19) ; v1(85.36,179.39) 85.36,188.4 86.43,189.48 105.19,189.48 ; v1(288.56,128.59) 288.56,137.6 289.63,138.68 308.39,138.68 ; 257.59,240.28 238.83,240.28 237.76,239.2 v1(237.76,230.19) ; 257.59,189.48 238.83,189.48 237.76,188.4 v1(237.76,179.39) ; v1(186.96,179.39) 186.96,188.4 188.03,189.48 206.79,189.48 ; v1(34.56,128.59) 34.56,137.6 35.63,138.68 54.39,138.68 ; 308.39,87.88 289.63,87.88 288.56,86.8 v1(288.56,77.79) ; 54.39,87.88 35.63,87.88 34.56,86.8 v1(34.56,77.79) ; 155.99,291.08 137.23,291.08 136.16,290 v1(136.16,280.99) ; 155.99,138.68 137.23,138.68 136.16,137.6 v1(136.16,128.59) ; v1(34.56,26.99) 34.56,36 35.63,37.08 54.39,37.08 ; 308.39,291.08 289.63,291.08 288.56,290 v1(288.56,280.99) ; 54.39,240.28 35.63,240.28 34.56,239.2 v1(34.56,230.19) ; 54.39,291.08 35.63,291.08 34.56,290 v1(34.56,280.99) ; 105.19,291.08 86.43,291.08 85.36,290 v1(85.36,280.99) ; 308.39,341.88 289.63,341.88 288.56,340.8 v1(288.56,331.79) ; 308.39,189.48 289.63,189.48 288.56,188.4 v1(288.56,179.39) ; 155.99,240.28 137.23,240.28 136.16,239.2 v1(136.16,230.19) ; 54.39,189.48 35.63,189.48 34.56,188.4 v1(34.56,179.39) ; v1(237.76,280.99) 237.76,290 238.83,291.08 257.59,291.08 ; 155.99,189.48 137.23,189.48 136.16,188.4 v1(136.16,179.39) ; v1(186.96,77.79) 186.96,86.8 188.03,87.88 206.79,87.88 ; v1(186.96,331.79) 186.96,340.8 188.03,341.88 206.79,341.88 ; 155.99,37.08 137.23,37.08 136.16,36 v1(136.16,26.99) ; v1(186.96,230.19) 186.96,239.2 188.03,240.28 206.79,240.28 ; 105.19,87.88 86.43,87.88 85.36,86.8 v1(85.36,77.79) ; 155.99,341.88 137.23,341.88 136.16,340.8 v1(136.16,331.79) ; 257.59,341.88 238.83,341.88 237.76,340.8 v1(237.76,331.79) ; v1(136.16,77.79) 136.16,86.8 137.23,87.88 155.99,87.88 ; v1(237.76,128.59) 237.76,137.6 238.83,138.68 257.59,138.68 ; 105.19,341.88 86.43,341.88 85.36,340.8 v1(85.36,331.79) ; v1(186.96,128.59) 186.96,137.6 188.03,138.68 206.79,138.68 ; 257.59,87.88 238.83,87.88 237.76,86.8 v1(237.76,77.79) ; v1(85.36,26.99) 85.36,36 86.43,37.08 105.19,37.08 ; 105.19,240.28 86.43,240.28 85.36,239.2 v1(85.36,230.19) ; 257.59,37.08 238.83,37.08 237.76,36 v1(237.76,26.99) ; 105.19,138.68 86.43,138.68 85.36,137.6 v1(85.36,128.59)
